# EasyEDA Pro project SMOL_ICM_NIKKI.eprj, board smolBrain V3.0 pcb
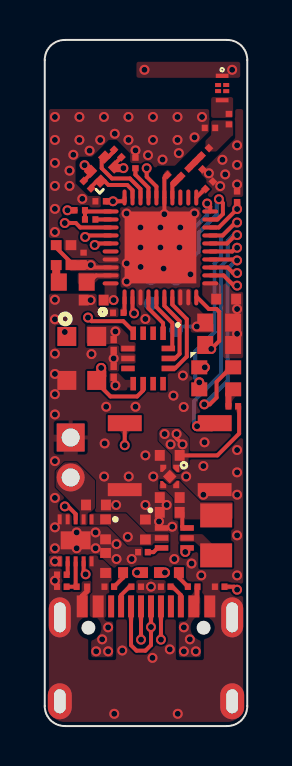
[diagram p1: board, top side]
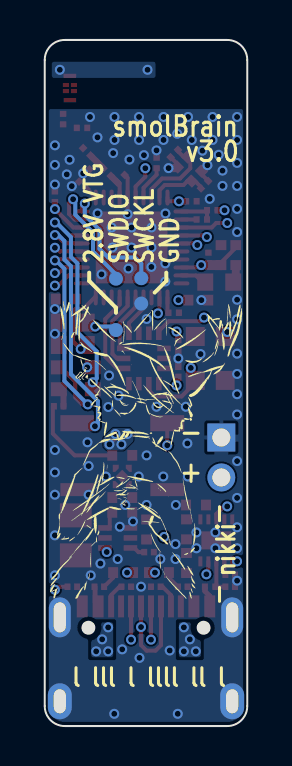
[diagram p2: board, bottom side, seen from below]

Outline 10.16 x 34.33 mm; copper layers: Top Layer, Inner1, Inner2, Bottom Layer. Coordinates in mm from the lower left corner of the outline.
Outline path: 0,33.33 0,1 arc(0.29,0.29) 1,0 9.16,0 arc(9.87,0.29) 10.16,1 10.16,33.33 arc(9.87,34.04) 9.16,34.33 1,34.33 arc(0.29,34.04) 0,33.33
Stack: Top Layer 0.035mm 外层铜厚1oz / Dielectric1 0.28mm 7628 RC49% 8.6mil / Inner1 0.035mm 内层铜厚 / Dielectric2 0.28mm 1.1mm H/HOZ 含铜 / Inner2 0.035mm 内层铜厚 / Dielectric3 0.28mm 7628 RC49% 8.6mil / Bottom Layer 0.035mm 外层铜厚1oz

## Design rules (mm)
template: 用户自定义配置
spacing Default (default): track to track 0.127, other pairs 0 to 0.127
track width Default (default): min 0.127, default 0.127, max 25.4
differential pair differentialPair (default): width min 0.127, default 0.254, max 2.54; gap min 0.152, default 0.152
via Default (default): diameter min 0.5, default 0.61, max 100.025; hole min 0.3, default 0.305, max 59.995
pour e1416 uses gge20888(1)
pour e4132 uses gge20888(1)
pour e2987 uses gge20888(1)
pour e1407 uses gge20879(1)
pour e14877 uses gge20879(1)
pour e549 uses gge20888(1)
pour e1523 uses gge20888(1)
pour e12385 uses gge20888(1)
pour e20004 uses gge20888(1)
pour e3180 uses gge20888(1)
pour e3773 uses gge20888(1)
pour e3047 uses gge20888(1)
pour e4169 uses gge20888(1)
pour e3992 uses gge20888(1)
pour e1278 uses gge20888(1)
pour e6562 uses gge20888(1)
pour e42617 uses gge20888(1)
pour e8610 uses gge20888(1)
pour e18302 uses gge20879(1)
pour e18731 uses gge20879(1)
pour e19536 uses gge20879(1)
pour e19197 uses gge20879(1)
pour e96 uses gge20888(1)
pour e97 uses gge20888(1)
pour e1568 uses gge20888(1)
pour e23691 uses gge20888(1)
pour e15014 uses gge20888(1)
pour e20957 uses gge20888(1)
pour e34543 uses gge20888(1)
pour e9155 uses gge20888(1)
pour e212 uses gge20888(1)
pour e625 uses gge20888(1)
pour e636 uses gge20888(1)
pour e632 uses gge20888(1)
pour e29798 uses gge20888(1)
pour e3830 uses gge20888(1)
pour e13634 uses gge20888(1)
pour e16726 uses gge20888(1)
pour e0 uses gge20888(1)
pour e2052 uses gge20888(1)

## Placement (name value [footprint] x y rotation side)
C1  100nF  [R0201#2]  3.69 20.68 180 top
C2  4.7uF  [C0603]  8.75 20.19 180 top
C3  4.7uF  [C0603]  8.75 19.07 180 top
C4  4.7uF  [C0402 small]  9.1 21.37 180 top
C5  100nF  [R0201#2]  9.65 26.49 270 top
C6  820pF  [R0201#2]  8.25 27.06 225 top
C7  100pF  [R0201#2]  4.55 28.18 270 top
C8  1uF  [C0402 small]  2.45 21.32 180 top
C9  1uF  [C0402 small]  1.31 23.57 270 top
C10  47nF  [R0201#2]  1.95 23.43 270 top
C11  12pF  [R0201#2]  3.66 28.65 315 top
C12  12pF  [R0201#2]  2.14 27.09 135 top
C13  100nF  [R0201#2]  2.8 26.26 180 top
C14  1pF  [R0201#2]  6.34 27.39 315 top
C15  1.2pF  [R0201#2]  7.73 28.04 135 top
C21  100nF  [C0201]  3.46 17.72 270 top
C22  100nF  [C0201]  3.46 19.07 90 top
C61  10uF  [C0402 small]  5.05 9.83 270 top
C62  10uF  [C0402 small]  6.27 10.69 180 top
C63  10uF  [C0402 small]  6.27 11.43 180 top
C64  10uF  [C0402 small]  6.27 13.55 180 top
C71  22uF  [C0402 small]  3.05 9.84 270 top
C72  2.2uF  [C0402 small]  3.05 8.16 90 top
C73  2.2uF  [C0402 small]  2.57 11.06 180 top
C74  47pF  [R0201#2]  1.86 6.97 180 top
H1  PZ200V-11-02P  [HDR-TH_2P-P2.00-V-M]  1.3 13.44 270 top
L4  4.7nH  [R0201#2]  7.03 27.72 45 top
L5  2.2nH  [R0201#2]  8.05 28.74 45 top
L6  10uH  [L0603]  1.4 22.22 180 top
L7  15nH  [C0402 small]  0.58 23.57 90 top
L61  1uH  [L0806]  8.6 9.54 90 top
LED1  NH-B2020RGBA-HF  [LED-ARRAY-SMD_4P-L2.1-W2.1-TL_NH-B2020RGBA]  8.6 17.4 0 top
LED2  XL-1005UWC  [C0402 small]  4.43 7.68 180 top
LED3  MHT136CRCT  [LED0402-R-RD]  6.23 7.68 0 top
NOREF  -  [Pad_e7102]  6.59 19.82 0 top
NOREF#2  -  [Pad_e3691]  6.59 22.39 0 top
NOREF#3  -  [Pad_e3692]  5.32 21.14 0 top
NOREF#4  -  [Pad_e3455]  5.32 22.41 0 top
R12  1.5nH  [R0201#2]  9.24 30.37 90 top
R31  1MΩ  [R0201#2]  2.28 25.35 180 top
R32  1MΩ  [R0201#2]  1.75 25.81 180 top
R61  162kΩ  [R0201]  4.93 8.7 0 top
R71  24kΩ  [R0201]  0.86 7.57 0 top
R72  7.5kΩ  [R0201]  0.86 6.97 0 top
R73  10kΩ  [R0201]  8.78 6.97 0 top
RD1  5.1kΩ  [R0201]  4.59 6.97 180 top
RD2  5.1kΩ  [R0201]  6.07 6.97 0 top
RL1  5.1kΩ  [R0201]  9.46 16 180 top
RL2  5.1kΩ  [R0201]  3.24 6.97 180 top
RL3  5.1kΩ  [R0201]  7.42 6.97 0 top
SW1  B3U-1000P  [KEY-SMD_B3U-1000PM]  8.53 13.46 270 top
SW2  B3U-1000P  [KEY-SMD_B3U-1000PM]  4.01 13.46 270 top
U6  NRF52833-QDAA-R7  [QFN-40_L5.0-W5.0-P0.40-TL-EP3.6]  5.8 23.95 90 top
U7  ICM-45686  [LGA-14_L3.0-W2.5-P0.50-TL]  5.19 18.4 270 top
U10  2.9nH  [R0201#2]  8.29 29.93 180 top
U11  BQ25185DLHR  [WSON-10_L2.2-W2.0-P0.40-BL-EP_TI_DLH0010A]  1.55 9.29 180 top
U13  TPS628438DRLR  [SOT-563-6_L1.6-W1.2-P0.5-LS1.6-BR]  6.5 9.41 180 top
U14  ANT016008LCS2442MA2  [ANT-SMD_6P-L1.6-W0.8-P1.20]  8.9 31.93 270 top
U15  TPS7A2028PDQNR  [UDFN-4_L1.0-W1.0-P0.65-TL]  6.27 12.49 270 top
USB1  TYPE-C 16PIN 2MD(073)  [USB-C-SMD_TYPE-C-6PIN-2MD-073]  5.08 3.61 0 top
X2  32MHz  [CRYSTAL-SMD_4P-L1.6-W1.2-BL]  2.9 27.87 45 top
X4  32.768kHz  [OSC-SMD_4P-L3.2-W2.5-CJ13-320001210A20]  1.86 18.4 270 top

## Footprints (pads in the part's own frame, mm; a bottom-side part is the same pattern mirrored in y, then rotated)
ANT-SMD_6P-L1.6-W0.8-P1.20
  rect 0.21x0.64 smd: 1(-0.612,0) 4(0.612,0)
  rect 0.2x0.3 smd: 2(-0.15,0.203) 3(0.158,0.204) 5(0.154,-0.204) 6(-0.148,-0.204)
C0201
  rect 0.368x0.324 smd: 1(-0.275,0) 2(0.275,0)
C0402 small
  rect 0.5x0.54 smd: 1(-0.5,0) 2(0.5,0)
C0603
  rect 0.8x0.9 smd: 1(-0.7,0) 2(0.7,0)
CRYSTAL-SMD_4P-L1.6-W1.2-BL
  rect 0.5x0.45 smd: 1(-0.5,-0.35) 2(0.5,-0.35) 3(0.5,0.35) 4(-0.5,0.35)
HDR-TH_2P-P2.00-V-M
  rect 1.4x1.4 hole 0.9: 1(-1,0)
  round 1.4 hole 0.9: 2(1,0)
KEY-SMD_B3U-1000PM
  rect 0.8x1.7 smd: 1(-1.7,0)
  rect 0.65x1.7 smd: 2(1.625,-0.002)
L0603
  rect 0.8x0.864 smd: 1(-0.7,0) 2(0.7,0)
L0806
  rect 1.2x1.6 smd: 1(-1,0) 2(1,0)
LED0402-R-RD
  rect 0.5x0.54 smd: 1(0.5,0) 2(-0.5,0)
LED-ARRAY-SMD_4P-L2.1-W2.1-TL_NH-B2020RGBA
  rect 0.8x0.7 smd: 1(-0.85,0.55) 2(0.85,0.55) 3(0.85,-0.55) 4(-0.85,-0.55)
LGA-14_L3.0-W2.5-P0.50-TL
  rect 0.675x0.28 smd: 1(-1.262,0.75) 2(-1.262,0.25) 3(-1.262,-0.25) 4(-1.262,-0.75) 8(1.262,-0.75) 9(1.262,-0.25) 10(1.262,0.25) 11(1.262,0.75)
  rect 0.28x0.675 smd: 5(-0.5,-1.012) 6(0,-1.012) 7(0.5,-1.012) 12(0.5,1.012) 13(0,1.012) 14(-0.5,1.012)
OSC-SMD_4P-L3.2-W2.5-CJ13-320001210A20
  rect 0.95x0.95 smd: 1(-1.1,-0.75) 2(1.1,-0.75) 3(1.1,0.75) 4(-1.1,0.75)
Pad_e3455
  round 0.7 smd far side: TP2(0,0)
Pad_e3691
  round 0.7 smd far side: TP5(0,0)
Pad_e3692
  round 0.7 smd far side: TP6(0,0)
Pad_e7102
  round 0.7 smd far side: TP7(0,0)
QFN-40_L5.0-W5.0-P0.40-TL-EP3.6
  oval 0.8x0.2 smd: 1(-2.499,1.8) 2(-2.499,1.4) 3(-2.499,1) 4(-2.499,0.6) 5(-2.499,0.2) 6(-2.499,-0.2) 7(-2.499,-0.6) 8(-2.499,-1) 9(-2.499,-1.4) 10(-2.499,-1.8) 21(2.499,-1.8) 22(2.499,-1.4) 23(2.499,-1) 24(2.499,-0.6) 25(2.499,-0.2) 26(2.499,0.2) 27(2.499,0.6) 28(2.499,1) 29(2.499,1.4) 30(2.499,1.8)
  oval 0.2x0.8 smd: 11(-1.8,-2.499) 12(-1.4,-2.499) 13(-1,-2.499) 14(-0.6,-2.499) 15(-0.2,-2.499) 16(0.2,-2.499) 17(0.6,-2.499) 18(1,-2.499) 19(1.4,-2.499) 20(1.8,-2.499) 31(1.8,2.499) 32(1.4,2.499) 33(1,2.499) 34(0.6,2.499) 35(0.2,2.499) 36(-0.2,2.499) 37(-0.6,2.499) 38(-1,2.499) 39(-1.4,2.499) 40(-1.8,2.499)
  rect 3.6x3.6 smd: 41(0,0)
R0201
  rect 0.303x0.324 smd: 1(-0.241,0) 2(0.241,0)
R0201#2
  rect 0.303x0.324 smd: 1(-0.262,0) 2(0.262,0)
SOT-563-6_L1.6-W1.2-P0.5-LS1.6-BR
  rect 0.68x0.28 smd: 1(0.64,-0.5) 2(0.64,0) 3(0.64,0.5) 4(-0.64,0.5) 5(-0.64,0) 6(-0.64,-0.5)
UDFN-4_L1.0-W1.0-P0.65-TL
  custom 0.36x0.3 smd: 1(-0.421,0.326) 2(-0.421,-0.325) 3(0.421,-0.326) 4(0.421,0.325)
  rect 0.48x0.48 smd rot 135: 5(0.002,0.001)
USB-C-SMD_TYPE-C-6PIN-2MD-073
  rect 0.55x1.1 smd: 1(-3.2,2.375) 2(-2.4,2.375) 11(2.4,2.375) 12(3.2,2.375)
  rect 0.3x1.1 smd: 3(-1.75,2.375) 4(-1.25,2.375) 5(-0.75,2.375) 6(-0.25,2.375) 7(0.25,2.375) 8(0.75,2.375) 9(1.25,2.375) 10(1.75,2.375)
  oval 1.1x2 hole 0.6x1.5: 13(-4.325,1.825) 14(4.325,1.825)
  oval 1.2x1.8 hole 0.6x1.2: 13(-4.325,-2.375) 14(4.325,-2.375)
WSON-10_L2.2-W2.0-P0.40-BL-EP_TI_DLH0010A
  rect 0.2x0.5 smd: 1(-0.8,-1.05) 2(-0.4,-1.05) 3(0,-1.05) 4(0.4,-1.05) 5(0.8,-1.05) 6(0.8,1.05) 7(0.4,1.05) 8(0,1.05) 9(-0.4,1.05) 10(-0.8,1.05)
  rect 1.5x0.9 smd: 11(0,0)

## Nets
As in the schematic, except:
2V8: C2.2 C5.2 C8.1 C13.1 C21.2 C22.2 C64.1 NOREF.TP7 RL1.1 U6.8 U6.9 U6.18 U6.30 U6.40 U7.5 U7.8 U15.1 X4.4
GND: C1.2 C2.1 C3.1 C4.1 C5.1 C6.1 C7.1 C8.2 C9.1 C10.1 C11.2 C12.2 C13.2 C14.1 C15.1 C21.1 C22.1 C61.1 C62.2 C63.2 C64.2 C71.2 C72.2 C73.1 C74.1 H1.1 NOREF#3.TP6 R61.1 R71.1 R72.1 R73.1 RD1.1 RD2.1 SW1.2 SW2.2 U6.3 U6.25 U6.37 U6.41 U7.6 U10.2 U11.4 U11.5 U11.11 U13.1 U15.2 U15.5 USB1.1 USB1.12 USB1.13 USB1.14 X2.2 X2.4 X4.2
SWCKL: NOREF#4.TP2 U6.20
SWDIO: NOREF#2.TP5 U6.19

Pads without a net: U6 22 23 36; U7 2 3 7 10 11; U14 2 3 5 6; USB1 3 9

## Via types
v1: diameter 0.5, hole 0.3, Top Layer to Bottom Layer, 163 vias

## Routing (per net, layer and track width the routed paths; a pad name or vN(x,y) marks a point on that pad's centre or on a via; arc(x,y) is an arc through that point)
2V8: length 25
  Top Layer w0.2: v1(6.91,14.1) 6.61,14.4 v1(6.61,14.61) ; 9.65,25.87 8.73,24.95 U6.18 ; 3.43,26.26 4,26.26 4,26.45 ; 9.75,16 9.75,14.64 8.66,13.55 C64.1
  Top Layer w0.303: 3.43,26.26 v1(3.42,26.26) 3.07,26.26 ; C5.2 v1(9.65,25.87)
  Inner2 w0.3: v1(7.63,19.99) 7.87,20.23 7.87,23.17 8.39,23.7 8.39,24.69 9.58,25.87 v1(9.65,25.87)
  Inner2 w0.5: v1(3.45,21.32) 3.45,23.42 3.68,23.65 3.68,24.55 3.42,24.81 v1(3.42,26.26)
  Inner2 w0.6: v1(3.45,21.32) 3.5,21.36 5.05,21.36 6.24,20.17
  Bottom Layer w0.2: v1(7.63,19.99) 6.76,19.99 NOREF.TP7
  vias: v1(3.55,19.75) v1(3.55,17.05) v1(6.01,14.61) v1(6.31,14.1)
+5V: length 22.1
  Top Layer w0.2: U6.10 7.63,21.48 8.23,20.87 8.62,20.87 8.75,20.74 8.75,19.27 v1(8.35,18.87)
  Top Layer w0.242: 7.63,6.97 7.63,6.17
  Inner2 w0.2: v1(8.35,18.87) 8.52,18.71 8.52,7.51 7.16,6.15 5.39,6.15 4.18,4.94 v1(3.18,4.94)
  vias: v1(2.58,3.74) v1(2.88,4.34) v1(3.18,3.74) v1(6.98,4.94) v1(6.98,3.74) v1(7.28,4.34) v1(7.58,3.74)
GND: length 5.3
  Top Layer w0.2: C12.2 2.3,27.62 2.3,27.77 ; 3.84,28.47 3.5,28.12 X2.2 ; C14.1 6,27.43 6,25.62 v1(6,25.62)
  Top Layer w0.254: C74.1 2.13,6.75 1.88,6.5 USB1.1
  Top Layer w0.4: v1(2,28.07) 2.3,27.77 ; X2.2 3.56,27.92 v1(3.95,27.92)
  vias: v1(0.51,30.48) v1(0.51,29.33) v1(0.51,28.18) v1(0.51,27.03) v1(0.51,25.88) v1(0.51,24.72) v1(0.51,21.33) v1(0.51,20.36) v1(0.51,18.64) v1(0.51,17.62) v1(0.51,16.61) v1(0.51,15.59) v1(0.51,13.26) v1(0.51,11.42) v1(0.51,9.94) v1(0.51,8.9) v1(0.51,7.27) v1(1.24,27.79) v1(1.24,27.03) v1(1.43,28.59) v1(1.6,9.69) v1(1.6,8.9) v1(1.74,30.48) v1(1.74,29.33) v1(1.88,26.38) v1(2.25,28.79) v1(2.3,21.32) v1(2.34,18.62) v1(2.55,9.69) v1(2.55,8.9) v1(2.78,29.33) v1(2.97,30.48) v1(3,14.14) v1(2.98,12.49) v1(3.08,15.98) v1(3.51,29.64) v1(3.46,18.4) v1(3.49,0.61) v1(3.58,11.06) v1(3.6,9.1) v1(3.6,8.36) v1(3.89,3.78) v1(4.11,25.65) v1(4.11,23.15) v1(4.11,22.25) v1(4.2,30.48) v1(4.2,29.33) v1(4.21,12.49) v1(4.36,8.36) v1(4.55,28.81) v1(4.55,15.98) v1(4.8,24.95) v1(4.8,23.95) v1(4.81,22.98) v1(5.05,20.37) v1(5.05,13.55) v1(5.05,11.06) v1(5.18,28.57) v1(5.33,6.97) v1(5.43,30.48) v1(5.43,29.33) v1(5.44,12.49) v1(5.41,3.41) v1(5.73,10.24) v1(5.8,24.95) v1(5.8,23.95) v1(5.91,28.35) v1(5.96,22.89) v1(6.12,11.06) v1(6.27,3.84) v1(6.4,9.97) v1(6.46,16.54) v1(6.5,8.36) v1(6.66,30.48) v1(6.66,29.33) v1(6.73,28.67) v1(6.67,0.61) v1(6.8,24.95) v1(6.76,23.95) v1(6.93,17.54) v1(6.97,15.97) v1(7.09,12.49) v1(7.31,22.61) v1(7.37,8.13) v1(7.51,29.46) v1(7.51,25.66) v1(7.89,30.48) v1(7.85,7.54) v1(8.02,14.2) v1(7.96,13.01) v1(7.96,11.58) v1(8.23,27.66) v1(8.8,27.02) v1(8.91,28.34) v1(9.05,27.61) v1(9.65,29.06) v1(9.65,28.08) v1(9.65,27.1) v1(9.65,20.87) v1(9.65,19.63) v1(9.65,13.81) v1(9.65,12.69) v1(9.65,11.58) v1(9.65,9.54) v1(9.65,7.54)
VIN: length 3.2
  Inner2 w0.2: v1(4.17,9.47) 4.55,9.08 6.68,9.08 v1(7.05,8.71)
ADC: length 1.8
  Top Layer w0.2: R31.2 R32.1 2.08,25.75 U6.31
B: length 11.9
  Top Layer w0.2: v1(8,16.1) 8.28,16.1 8.62,16.44 8.62,17.23 9.12,17.73 9.45,17.73 ; v1(9.65,23.3) 9.6,23.35 U6.14
  Bottom Layer w0.2: v1(8,16.1) 9.17,17.27 9.17,22.88 9.59,23.3 v1(9.65,23.3)
BAT+: length 15
  Top Layer w0.303: v1(1.14,25.81) R32.2
  Inner2 w0.2: H1.2 2.37,13.51 2.37,15.2 1.53,16.04 1.53,19.91 1.33,20.11 1.33,21.73 1.18,21.88 1.18,24.09 1.53,24.44 1.53,25.42 v1(1.14,25.81)
CS: length 4.4
  Top Layer w0.2: U7.12 6.53,17.9 7.13,18.49 7.13,20.37 6.4,21.09 U6.7
DIV_ONOFF: length 0.8
  Top Layer w0.2: U6.32 R31.1
DN: length 26.5
  Top Layer w0.2: USB1.5 4.33,4.04 4.6,3.77 5.05,3.77 5.33,4.05 v1(5.33,4.95) USB1.7 ; v1(9.65,22.04) 9.48,22.04 8.97,22.55 U6.12
  Inner2 w0.2: v1(5.33,4.95) 5.87,5.5 7.43,5.5 9.17,7.24 9.17,21.56 v1(9.65,22.04)
DP: length 27.4
  Top Layer w0.2: v1(9.65,22.67) 9.45,22.67 9.17,22.95 U6.13 ; USB1.6 v1(4.83,4.32) ; v1(5.83,4.32) USB1.8
  Inner2 w0.2: v1(9.65,22.67) 9.3,22.67 8.85,22.22 8.85,7.38 7.29,5.82 5.52,5.82 4.83,5.13 v1(4.83,4.32) v1(5.83,4.32)
G: length 11
  Top Layer w0.2: 8.27,24.55 8.93,24.55 9.58,25.2 9.62,25.2
  Top Layer w0.5: 7.75,16.81 7.75,16.81 v1(7.75,17.2)
  Bottom Layer w0.2: v1(9.65,25.2) 9.58,25.2 8.85,24.47 8.85,23.48 8.52,23.15 8.52,19.71 7.55,18.75 7.55,17.4 v1(7.75,17.2)
INT: length 8
  Top Layer w0.2: v1(2.17,20.44) 2.35,20.26 3.94,20.26 4.44,19.76 4.44,19.7 ; v1(2.51,24.07) 2.58,24.15 U6.35
  Inner2 w0.2: v1(2.17,20.44) 2.81,21.08 2.81,21.54 1.83,22.52 1.83,23.4 v1(2.51,24.07)
R: length 8.5
  Top Layer w0.2: U6.15 9.41,23.75 9.6,23.94 v1(9.65,23.94)
  Top Layer w0.5: v1(8.03,17.95) LED1.1 7.75,17.95
  Inner2 w0.2: v1(9.65,23.94) 9.6,23.94 8.52,22.86 8.52,19.73 7.88,19.09 7.88,18.1 8.03,17.94
RAD:
  vias: v1(5,32.84) v1(9.4,32.84)
REF_CLK: length 8.8
  Top Layer w0.2: v1(4.48,20.65) 4.4,20.73 U6.2 ; 2.83,17.52 2.83,16.96 3.3,16.49 4.63,16.49 4.94,16.8 U7.9
  Top Layer w0.5: v1(2.83,17.92) 2.83,17.52 X4.3
  Inner2 w0.2: v1(4.48,20.65) 3.62,20.65 2.83,19.87 v1(2.83,17.92)
REF_CLK_EN: length 8
  Top Layer w0.2: U6.33 1.78,24.95 1.56,25.17 v1(1,25.17) ; 1,25.17 1,25.17
  Inner2 w0.2: v1(1,19.72) 1,21.59 0.85,21.74 0.85,24.23 1,24.38 v1(1,25.17)
RESET: length 13.1
  Top Layer w0.2: U6.16 9.15,24.15 9.57,24.57
  Top Layer w0.5: SW1.1 8.38,15 v1(7.64,15)
  Bottom Layer w0.2: v1(9.65,24.57) 9.47,24.57 9.17,24.27 9.17,23.34 8.85,23.02 8.85,17.61 7.49,16.26 7.49,15.08 7.57,15 v1(7.64,15)
SCL: length 3.8
  Top Layer w0.2: U6.6 6,21.03 6.76,20.27 6.76,18.62 6.54,18.4 U7.13
SDA: length 3
  Top Layer w0.2: U6.5 5.6,20.96 6.4,20.17 6.4,18.97 6.33,18.9 U7.14
SDO: length 2.1
  Top Layer w0.2: U6.4 5.2,20.9 5.94,20.17 U7.1
STAT1: length 5.3
  Top Layer w0.2: v1(2.05,7.59) 1.95,7.69 1.95,8.22
  Top Layer w0.5: v1(6.03,7.68) LED3.2
  Inner2 w0.2: v1(6.03,7.68) 5.3,7.68 4.83,7.2 2.65,7.2 2.26,7.59 v1(2.05,7.59)
STAT2: length 7.7
  Top Layer w0.2: v1(1.01,10.99) 1.17,10.99 1.55,10.61 U11.3
  Top Layer w0.5: v1(4.63,7.68) LED2.1
  Inner2 w0.2: v1(4.63,7.68) 4.48,7.53 2.79,7.53 2.25,8.07 1.75,8.07 1.06,8.76 1.06,10.94 v1(1.01,10.99)
SW0: length 14.1
  Top Layer w0.2: v1(2.03,24.47) 2.1,24.55 U6.34 ; v1(4.01,14.05) 4.01,15.15
  Inner2 w0.2: v1(2.03,24.47) 1.51,23.96 1.51,22.02 1.66,21.86 1.66,20.24 1.86,20.04 1.86,16.18 3.98,14.05 v1(4.01,14.05)
SWCKL: length 6.3
  Top Layer w0.2: v1(8.15,26.15) 8.3,26 U6.20
  Bottom Layer w0.2: 5.32,22.29 5.32,23.14 5.62,23.45 6.97,23.45 7.41,23.88 7.41,24.83 8.15,25.57 v1(8.15,26.15)
SWDIO: length 6.3
  Top Layer w0.2: U6.19 8.66,25.35 8.94,25.62 8.94,26.17 v1(8.74,26.37)
  Bottom Layer w0.2: 6.59,22.6 7.74,23.75 7.74,24.7 8.63,25.59 8.63,26.28 8.74,26.39
$1N2030: length 1.3
  Top Layer w0.2: RD1.2 4.25,6.97 3.83,6.55 USB1.4
$1N2031: length 1.3
  Top Layer w0.2: USB1.10 6.83,6.55 6.41,6.97 RD2.2
$1N108586: length 4.1
  Top Layer w0.2: X2.3 2.86,28.32 2.86,27.92 3.37,27.4 4.27,27.4 4.8,26.88 4.8,26.45 ; 3.04,28.49 3.2,28.49 3.53,28.83
$1N109226: length 0.7
  Top Layer w0.324: 7.32,28 C15.2 7.82,28.5
$1N109724: length 1.2
  Top Layer w0.2: 6.4,26.42 6.4,27.12
  Top Layer w0.324: 6.79,27.48 6.47,27.15
$1N109749: length 1.7
  Top Layer w0.2: 5.2,26.45 5.2,26.94 4.55,27.59 C7.2
$1N110127: length 11.7
  Top Layer w0.2: 5.6,26.45 5.6,27 5.11,27.49 v1(5.11,27.92) ; U6.38 2,22.95 ; 1.32,23.07 1.32,23.19 0.58,23.93 0.58,24.07 ; 2,23.22 C10.2
  Top Layer w0.5: C9.2 1.95,23.07
  Inner2 w0.3: v1(5.11,27.92) 4.73,27.92 3.65,26.84 3.19,26.84 2.85,26.5 2.85,24.55 3.08,24.33 3.08,23.84 v1(2.31,23.07)
$1N110150: length 1.4
  Top Layer w0.2: U6.39 2.58,22.55 2.14,22.12 2.1,22.12
$1N110162: length 0.9
  Top Layer w0.2: 3.93,20.65 3.99,20.65 4,20.66 U6.1
$1N110177: length 0.7
  Top Layer w0.2: 8.08,26.92 7.6,26.45
$1N127138: length 0.9
  Top Layer w0.4: L7.1 0.58,22.32 0.71,22.19
$1N127322: length 2.8
  Top Layer w0.2: 2.31,26.97 2.65,27.31 ; X2.1 3,27.27 3.2,27.08 4.14,27.08 4.4,26.81 4.4,26.45 ; 2.67,27.29 2.82,27.29
$1N127455: length 0.9
  Top Layer w0.303: RL1.2 9.22,16.62 LED1.3
$1N141272: length 0.7
  Top Layer w0.2: R71.2 1.15,7.62 1.15,8.22
$1N141329: length 1.7
  Top Layer w0.2: 1.1,6.97 1.6,6.97 1.55,7.02 1.55,8.17
$1N146947: length 1
  Top Layer w0.2: 6.9,10.7 6.9,9.97 6.99,9.88 ; 6.77,11.4 6.67,11.4
$1N151523: length 0.9
  Top Layer w0.2: RL2.1 3.93,7.42 LED2.2
$1N151616: length 0.9
  Top Layer w0.2: 7.18,6.97 6.73,7.42 LED3.1
$1N181655: length 19.7
  Top Layer w0.2: R73.2 9.5,6.97 v1(9.65,6.82)
  Inner2 w0.2: v1(0.51,8.24) 1.02,7.73 1.02,7.13 1.53,6.62 1.53,2.59 2.81,1.31 7.5,1.31 8.63,2.44 8.63,6.23 9.22,6.82 9.43,6.82
$1N203824: length 0.8
  Top Layer w0.2: R61.2 5.46,8.7 5.67,8.91 5.86,8.91

## Copper pours and planes (outline as drawn; the poured copper is in the pictures)
2V8 on Top Layer: 6.75,12.72 6.65,12.72 6.44,12.92 6.44,14.2 6.66,14.42 7.17,14.42 7.17,13.14
2V8 on Top Layer: 3.73,19.16 3.84,19.05 3.84,18.76 4.56,18.76 4.56,19.13 3.69,20 2.13,20 2.13,19.16
2V8 on Top Layer: 5.76,14.72 5.91,14.87 6.72,14.87 7.17,14.42 7.17,13.75 6.83,13.42 6.64,13.42 5.76,14.29
2V8 on Top Layer: 6.7,21.15 7.38,20.47 7.38,19.74 8.45,19.74 8.45,20.08 7.3,21.22 7.3,21.85 6.7,21.85
2V8 on Bottom Layer: 5.76,14.72 5.91,14.87 6.72,14.87 7.17,14.42 7.17,13.99 7.02,13.84 6.21,13.84 5.76,14.29
2V8 on Inner1: 5.76,14.72 5.91,14.87 6.72,14.87 7.17,14.42 7.17,13.99 7.02,13.84 6.21,13.84 5.76,14.29
2V8 on Inner2: 5.76,14.72 5.91,14.87 6.72,14.87 7.17,14.42 7.17,13.99 7.02,13.84 6.21,13.84 5.76,14.29
2V8 on Inner2: 6.18,13.87 3.28,16.77 3.28,19.86 4.12,20.7 7.75,20.7 8.02,20.43 8.02,19.91 5.94,17.83 5.94,16.41 7.17,15.19 7.17,14.07 6.97,13.87
+5V on Top Layer: 6.68,6.54 7.88,6.54 7.88,3.4 6.68,3.4
+5V on Top Layer: 2.25,8.49 2.25,7.89 2.43,7.71 2.43,6.67 2.31,6.54 2.31,5.47 3.05,5.47 3.31,5.73 3.31,7.86 2.68,8.49
+5V on Top Layer: 2.28,6.54 3.48,6.54 3.48,3.4 2.28,3.4
+5V on Bottom Layer: 6.68,5.24 7.88,5.24 7.88,3.4 6.68,3.4
+5V on Bottom Layer: 2.28,5.24 3.48,5.24 3.48,3.4 2.28,3.4
+5V on Inner1: 6.68,5.24 7.88,5.24 7.88,3.4 6.68,3.4
+5V on Inner1: 2.28,5.24 3.48,5.24 3.48,3.4 2.28,3.4
+5V on Inner2: 2.28,5.24 3.48,5.24 3.48,3.52 3.99,3.01 6.07,3.01 6.68,3.62 6.68,5.24 7.88,5.24 7.88,2.85 6.91,1.88 3.2,1.88 2.28,2.8
GND on Top Layer: -10.51,44.54 15.74,44.54 15.74,-6.38 -10.51,-6.38
GND on Bottom Layer: -5.08,44.42 10.92,44.42 10.92,-6.64 -5.08,-6.64
GND on Inner1: 0,37.69 10.16,37.69 10.16,-8.29 0,-8.29
GND on Inner2: 0,37.74 10.16,37.74 10.16,-3.92 0,-3.92
VIN on Top Layer: 2.25,10.09 3.19,10.09 4.19,9.08 6.2,9.08 6.2,9.58 5.06,9.58 4.06,10.59 2.25,10.59
BAT+ on Top Layer: 1.8,10.09 1.8,10.77 0.6,11.97 0.6,12.74 1.01,13.15 1.59,13.15 2.47,12.27 2.47,10.94 2.13,10.59 2.13,10.09
RAD on Top Layer: 4.7,33.14 9.7,33.14 9.7,32.54 4.7,32.54
RAD on Bottom Layer: 4.7,33.14 9.7,33.14 9.7,32.54 4.7,32.54
$1N109017 on Top Layer: 7.9,22.25 7.9,21.49 8.3,21.1 8.85,21.1 8.85,22.04 8.65,22.25
$1N110127 on Top Layer: 1.23,23.25 1.29,23.32 2.42,23.32 2.68,23.05 3.7,23.05 3.7,22.82 1.32,22.82 1.23,22.9
$1N110150 on Top Layer: 1.71,22.15 2.42,22.15 2.68,22.42 3.7,22.42 3.7,22.65 1.71,22.65
$1N134854 on Top Layer: 8.24,28.7 8.62,28.7 9.4,29.48 9.4,30.03 9.17,30.25 8.96,30.25 8.02,29.31 8.02,28.93
$1N146947 on Top Layer: 6.7,12.26 6.62,12.26 6.35,11.99 6.06,11.99 6.06,11.89 6.52,11.43 6.52,11.03 7.85,11.03 7.85,11.11
$1N146947 on Top Layer: 6.52,11.17 9.4,11.17 9.4,10.39 6.52,10.39
$1N146997 on Top Layer: 6.8,9.55 7.89,9.55 9,8.44 9,8.25 8.85,8.1 7.9,8.1 7.9,8.94 7.54,9.27 6.8,9.27

Small or netless copper shapes (teardrops, artwork), in the pictures only: 67 on Top Layer, 11 on Bottom Layer, 2 on Inner1, 35 on Inner2

## Text on the board
Bottom Silkscreen Layer: nikki | l lll l llll ll l | SWCKL | SWDIO | GND | 2.8V VTG | v3.0 | smolBrain | - | +
Top Layer: To flash the NRF you need to power / tracker via battery or USB and then / you connect debuugger 4 pins to it. / Again, debugger does not power tracker, / you have to power via anything else. | VTG is so called Target Voltage pin. / It's a sence pin of a debugger to addapt to / the board voltage. it does not provide power, / it only sence voltage and makes signals equal to that.
